# EasyEDA Pro project WearableGasDetect.eprj, board PCB2
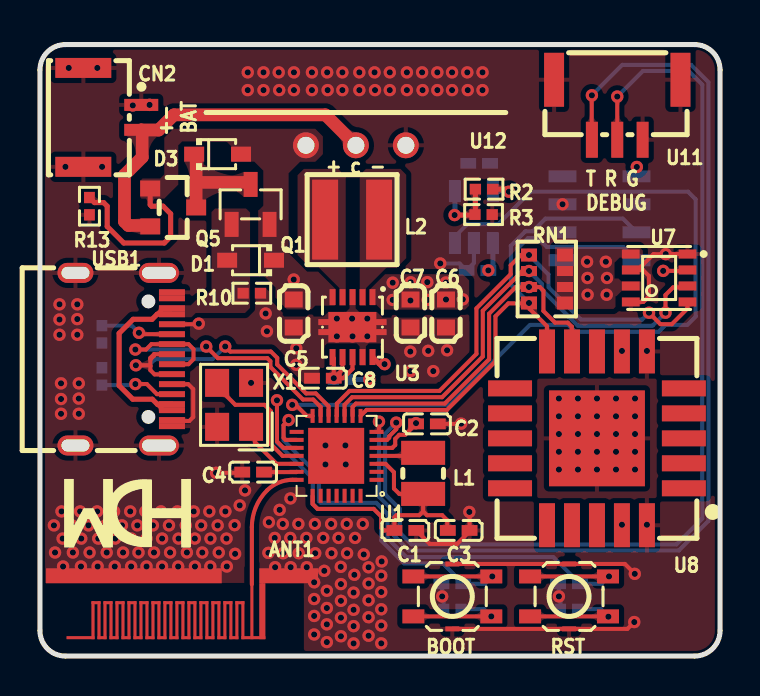
[diagram p8: board, top side]
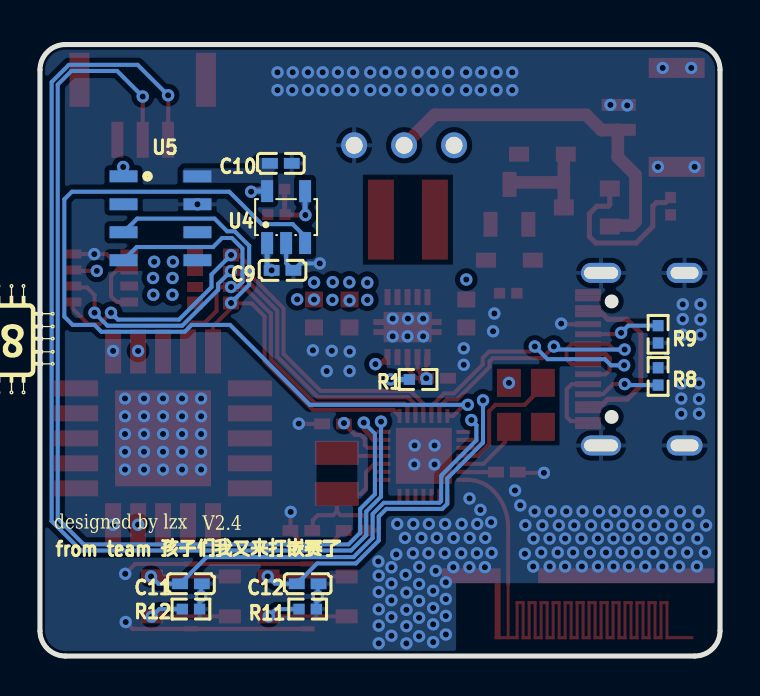
[diagram p9: board, bottom side, seen from below]

Outline 34.04 x 30.61 mm; copper layers: Top Layer, Inner1, Inner2, Bottom Layer. Coordinates in mm from the lower left corner of the outline.
Outline path: 0,29.34 0,1.27 arc(0.37,0.37) 1.27,0 32.77,0 arc(33.66,0.37) 34.04,1.27 34.04,29.34 arc(33.66,30.24) 32.77,30.61 1.27,30.61 arc(0.37,30.24) 0,29.34
Stack: Top Layer 0.035mm 外层铜厚1oz / Dielectric1 0.2104mm 7628 RC49% 8.6mil / Inner1 0.0152mm 内层铜厚 / Dielectric2 1.065mm 1.1mm H/HOZ 含铜 / Inner2 0.0152mm 内层铜厚 / Dielectric3 0.2104mm 7628 RC49% 8.6mil / Bottom Layer 0.035mm 外层铜厚1oz

## Design rules (mm)
template: JLCPCB Capability(Two Layers Board)
spacing copperThickness1oz (default): track to track 0.102, other pairs 0.152 to 0.3
spacing copperThickness2oz: track to track 0.203, other pairs 0.152 to 0.3
track width copperThickness1oz (default): min 0.127, default 0.254, max 2.54
track width copperThickness2oz: min 0.203, default 0.254, max 2.54
differential pair differentialPair (default): width min 0.127, default 0.254, max 2.54; gap min 0.152, default 0.152
via viaSize (default): diameter min 0.5, default 0.61, max 10; hole min 0.3, default 0.305, max 6.3

## Placement (name value [footprint] x y rotation side)
ANT1  -  [ANT-F-1-2.4G-0.8MMFR4-WCH]  10.6 3.59 180 top
BOOT  YTS-A007-1C  [SW-SMD_6P-L3.4-W3.4-P2.00-LS4.0]  20.64 2.98 0 top
C1  2.2uF  [C0402]  18.29 6.29 180 top
C2  2.2uF  [C0402]  19.37 11.62 180 top
C3  100nF  [C0402]  20.96 6.29 0 top
C4  1uF  [C0402]  10.67 9.21 180 top
C5  10uF  [C0603]  12.7 17.14 90 top
C6  10uF  [C0603]  20.32 17.14 270 top
C7  10uF  [C0603]  18.54 17.14 270 top
C8  100nF  [C0402]  14.16 13.91 0 top
C9  1uF  [C0402]  21.9 19.3 180 bottom
C10  1uF  [C0402]  21.98 24.66 0 bottom
C11  100nF  [C0402]  26.48 3.62 0 bottom
C12  100nF  [C0402]  20.64 3.62 0 bottom
CN2  WAFER-GH1.25-2PWB  [CONN-TH_2P-P1.25_XUNPU_WAFER-GH1.25-2PWB]  3.62 26.96 270 top
D1  1N5819WS  [SOD-323_L1.8-W1.3-LS2.5-RD]  10.54 19.81 180 top
D3  1N5819WS  [SOD-323_L1.8-W1.3-LS2.5-RD]  8.89 25.12 0 top
L1  10uH  [IND-SMD_L2.5-W2.0]  19.18 9.14 270 top
L2  2.2uH  [IND-SMD_L4.0-W4.0_VLS4012ET]  15.62 21.84 180 top
Q1  SI2301DS  [SOT-23-3_L2.9-W1.3-P1.90-LS2.4-BR]  10.54 22.61 270 top
Q5  -  [AO3401A_SOT-23-3]  6.67 22.45 180 top
R1  100  [R0402]  15.11 13.84 0 bottom
R2  8K  [R0402]  22.23 23.37 0 top
R3  50K  [R0402]  22.2 22.1 180 top
R8  5.1k  [R0402]  3.1 14 270 bottom
R9  5.1k  [R0402]  3.1 16.1 270 bottom
R10  100K  [R0402]  10.6 18.16 180 top
R11  10K  [R0402]  20.64 2.35 180 bottom
R12  10K  [R0402]  26.48 2.35 180 bottom
R13  10k  [R0402]  2.48 22.52 90 top
RN1  10kΩ  [RES-ARRAY-SMD_0603-8P-L3.2-W1.6-BL]  25.37 18.87 90 top
RST  YTS-A007-1C  [SW-SMD_6P-L3.4-W3.4-P2.00-LS4.0]  26.48 2.98 0 top
U1  CH582F  [QFN-28_L4.0-W4.0-P0.40-BL-EP2.8]  14.84 10.02 90 top
U3  TPS63001DRCT  [VSON-10_L3.0-W3.0-P0.50-TL-EP]  15.64 16.47 270 top
U4  SGM2019-ADJYN5G/TR  [SOT-23-5_L3.0-W1.7-P0.95-LS2.8-BR]  21.72 21.97 270 bottom
U5  -  [JED8101]  25.65 19.81 180 bottom
U7  BME688  [LGA-8_L3.0-W3.0-P0.80_BME688]  30.99 18.92 0 top
U8  SCD40-D-R1  [LGA-20_L10.1-W10.1-P1.25-TL]  27.88 10.9 180 top
U11  GH1.25-3PWBPZ  [CONN-SMD_GH1.25-3PWBPZ]  28.89 27.34 180 top
U12  PR5L5015-3P-C-H  [CONN-TH_PR5L5015-3P-C-H]  15.81 25.56 0 top
USB1  KH-TYPE-C-16P  [USB-C-SMD_KH-TYPE-C-16P]  4.19 14.86 270 top
X1  32MHz  [CRYSTAL-SMD_4P-L3.2-W2.5-BL]  9.72 12.57 90 top

## Footprints (pads in the part's own frame, mm; a bottom-side part is the same pattern mirrored in y, then rotated)
ANT-F-1-2.4G-0.8MMFR4-WCH
  rect 0.1x0.1 smd: 0(-0.525,0) 1(0,0)
AO3401A_SOT-23-3
  rect 1x0.8 smd: 1(1.15,-0.95) 2(1.15,0.95) 3(-1.15,0)
C0402
  rect 0.79x0.54 smd: 1(-0.545,0) 2(0.545,0)
C0603
  rect 0.8x0.9 smd: 1(-0.7,0) 2(0.7,0)
CONN-SMD_GH1.25-3PWBPZ
  rect 0.6x1.8 smd: 1(-1.27,1.501) 2(0,1.501) 3(1.27,1.501)
  rect 1x2.7 smd: 4(-3.163,-1.501) 5(3.163,-1.501)
CONN-TH_2P-P1.25_XUNPU_WAFER-GH1.25-2PWB
  rect 0.6x1.7 smd: 1(-0.625,1.45) 2(0.625,1.45)
  rect 1x2.8 smd: 3(-2.475,-1.45) 4(2.475,-1.45)
CONN-TH_PR5L5015-3P-C-H
  round 1.3 hole 0.85: 1(-2.5,0) 2(0,0) 3(2.5,0)
CRYSTAL-SMD_4P-L3.2-W2.5-BL
  rect 1.4x1.2 smd: 1(-1.1,-0.85) 2(1.1,-0.85) 3(1.1,0.85) 4(-1.1,0.85)
IND-SMD_L2.5-W2.0
  rect 1.2x2.2 smd: 1(1.028,0) 2(-1.028,0)
IND-SMD_L4.0-W4.0_VLS4012ET
  rect 1.3x4 smd: 1(-1.35,0) 2(1.35,0)
JED8101
  custom 1.4x0.6 smd: 1(-4.2,4.2) 2(-4.2,2.8) 3(-4.2,1.4) 4(-4.2,0) 5(-0.5,0) 6(-0.5,1.4) 7(-0.5,2.8) 8(-0.5,4.2)
LGA-8_L3.0-W3.0-P0.80_BME688
  rect 0.889x0.448 smd: 1(1.419,1.2) 2(1.419,0.4) 3(1.419,-0.4) 4(1.419,-1.2) 5(-1.419,-1.2) 6(-1.419,-0.4) 7(-1.419,0.4) 8(-1.419,1.2)
LGA-20_L10.1-W10.1-P1.25-TL
  rect 2.2x0.8 smd: 1(-4.35,2.5) 2(-4.35,1.25) 3(-4.35,0) 4(-4.35,-1.25) 5(-4.35,-2.5) 11(4.35,-2.5) 12(4.35,-1.25) 13(4.35,0) 14(4.35,1.25) 15(4.35,2.5)
  rect 0.8x2.2 smd: 6(-2.5,-4.35) 7(-1.25,-4.35) 8(0,-4.35) 9(1.25,-4.35) 10(2.5,-4.35) 16(2.5,4.35) 17(1.25,4.35) 18(0,4.35) 19(-1.25,4.35) 20(-2.5,4.35)
  rect 4.8x4.8 smd: 21(0,0)
QFN-28_L4.0-W4.0-P0.40-BL-EP2.8
  rect 0.2x0.7 smd: 1(-1.2,-2) 2(-0.8,-2) 3(-0.4,-2) 4(-0.001,-2) 5(0.4,-2) 6(0.8,-2) 7(1.2,-2) 15(1.2,2) 16(0.8,2) 17(0.4,2) 18(0,2) 19(-0.4,2) 20(-0.8,2) 21(-1.2,2)
  rect 0.7x0.2 smd: 8(2,-1.2) 9(2,-0.8) 10(2,-0.4) 11(1.999,0) 12(2,0.4) 13(2,0.8) 14(2,1.2) 22(-2,1.2) 23(-2,0.8) 24(-2,0.4) 25(-2,0) 26(-2,-0.4) 27(-2,-0.8) 28(-2,-1.2)
  rect 2.8x2.8 smd: 29(0.001,0.02)
R0402
  rect 0.566x0.54 smd: 1(-0.433,0) 2(0.433,0)
RES-ARRAY-SMD_0603-8P-L3.2-W1.6-BL
  rect 0.65x0.8 smd: 1(-1.2,-0.9) 4(1.2,-0.9) 5(1.2,0.9) 8(-1.2,0.9)
  rect 0.5x0.8 smd: 2(-0.4,-0.9) 3(0.4,-0.9) 6(0.4,0.9) 7(-0.4,0.9)
SOD-323_L1.8-W1.3-LS2.5-RD
  rect 1x0.75 smd: 1(-1.173,0) 2(1.173,0)
SOT-23-3_L2.9-W1.3-P1.90-LS2.4-BR
  rect 1.25x0.7 smd: 1(1,-0.95) 2(1,0.95) 3(-1,0)
SOT-23-5_L3.0-W1.7-P0.95-LS2.8-BR
  rect 1.1x0.6 smd: 1(1.3,-0.95) 2(1.3,0) 3(1.3,0.95) 4(-1.3,0.95) 5(-1.3,-0.95)
SW-SMD_6P-L3.4-W3.4-P2.00-LS4.0
  rect 1.1x0.7 smd: 1(-1.95,1) 2(1.95,1) 3(-1.95,-1) 4(1.95,-1)
  rect 0.7x0.25 smd: 5(0,1.625) 6(0,-1.625)
USB-C-SMD_KH-TYPE-C-16P
  oval 1x2 hole 0.6x1.7: 1(-4.32,1.765) 2(4.32,1.765)
  oval 1x1.8 hole 0.6x1.4: 3(-4.32,-2.415) 4(4.32,-2.415)
  rect 0.3x1.3 smd: A1(-3.35,2.415) A4(-2.55,2.415) A5(-1.25,2.415) A6(-0.25,2.415) A7(0.25,2.415) A8(1.25,2.415) A9(2.55,2.415) A12(3.35,2.415) B1(3.05,2.415) B4(2.25,2.415) B5(1.75,2.415) B6(0.75,2.415) B7(-0.75,2.415) B8(-1.75,2.415) B9(-2.25,2.415) B12(-3.05,2.415)
VSON-10_L3.0-W3.0-P0.50-TL-EP
  rect 0.8x0.3 smd: 1(-1.5,1) 2(-1.5,0.5) 3(-1.5,0) 4(-1.5,-0.5) 5(-1.5,-1) 6(1.5,-1) 7(1.5,-0.5) 8(1.5,0) 9(1.5,0.5) 10(1.5,1)
  custom 1.52x3.42 smd: 11(0.002,-0.009)

## Nets
As in the schematic.

Pads without a net: U1 1 2 15 23 24 25 26 27 28; U5 2 5 6; U8 1 2 3 4 5 8 11 12 13 14 15 16 17 18

## Via types
v1: diameter 0.62, hole 0.31, Top Layer to Bottom Layer, 272 vias

## Routing (per net, layer and track width the routed paths; a pad name or vN(x,y) marks a point on that pad's centre or on a via; arc(x,y) is an arc through that point)
1.4V: length 1.7
  Top Layer w0.254: R2.2 23.34,23.37 v1(23.47,23.24)
  Bottom Layer w0.254: v1(23.47,23.24) 23.44,23.27 U4.5
3.3V: length 6.6
  Top Layer w0.203: U7.2 32.36,19.28 v1(31.19,19.28) ; 18.82,11.66 C2.2 18.28,11.07 17.98,11.07 17.78,10.87 17.78,10.57 17.63,10.42 U1.5
  Top Layer w0.254: U3.10 17,14.61 v1(17.25,14.61)
  Bottom Layer w0.254: v1(29.87,24.48) 29.85,24.46 U5.1 ; v1(22.44,19.3) 22.67,19.53 U4.1
  vias: v1(17.65,18.69) v1(17.65,17.83) v1(18.55,18.71) v1(18.54,17.8) v1(18.82,11.66) v1(19.38,18.72) v1(19.4,17.83) v1(20.32,18.7) v1(20.32,17.84) v1(21.16,17.85) v1(27.38,19.74) v1(27.4,18.92) v1(27.41,18.08) v1(28.32,19.74) v1(28.38,18.92) v1(28.36,18.08) v1(29.13,15.27) v1(29.13,6.57)
GND: length 41.9
  Top Layer w0.203: v1(21.49,7.21) 21.5,7.2 C3.2 21.5,6.23 20.88,5.61 19.51,5.61 C1.1 ; C2.1 21.07,11.62 v1(21.08,11.63) ; 29.92,19.32 30.18,19.32 30.48,19.02 30.48,18.01 30.19,17.72 U7.5 ; 29.92,19.32 30.71,20.12 v1(31.32,20.12) 31.32,20.12 U7.1 ; 29.92,19.32 U7.7 ; C4.2 10.09,9.17 v1(8.81,9.17) ; 6.61,13.61 7.42,13.61 7.67,13.36 7.67,11.96 7.47,11.76 6.66,11.76 6.61,11.81 ; v1(29.77,4.11) 29.27,4.61 RST.5 BOOT.5 ; v1(7.95,16.64) 7.92,16.61 6.61,16.61 ; BOOT.6 RST.6 29.4,1.36 v1(29.74,1.7)
  Bottom Layer w0.203: R11.2 20.2,2.91 v1(20.13,2.98) 20.13,3.58 C12.1 ; U4.2 21.72,19.67 21.35,19.3 21,19.65 v1(20.03,19.65) ; R12.2 26.05,2.91 v1(25.97,2.98) 25.97,3.58 C11.1
  vias: v1(0.7,6.54) v1(0.75,5.18) v1(0.98,17.61) v1(0.98,16.84) v1(0.98,16.08) v1(1.05,13.65) v1(1.05,12.86) v1(1.05,12.13) v1(1.08,7.24) v1(1.14,5.88) v1(1.16,4.48) v1(1.27,24.49) v1(1.44,29.44) v1(1.59,6.54) v1(1.65,5.18) v1(1.87,17.61) v1(1.87,16.87) v1(1.87,16.08) v1(1.94,13.65) v1(1.94,12.89) v1(1.94,12.13) v1(2.01,7.24) v1(2.05,4.48) v1(2.07,5.88) v1(2.43,6.54) v1(2.48,5.18) v1(2.87,29.44) v1(2.86,7.24) v1(2.92,5.88) v1(2.89,4.48) v1(3.11,24.49) v1(3.29,6.54) v1(3.34,5.18) v1(3.71,7.24) v1(3.74,4.48) v1(3.76,5.88) v1(4.1,6.54) v1(4.16,5.18) v1(4.52,7.24) v1(4.65,27.56) v1(4.57,5.88) v1(4.56,4.48) v1(4.87,6.54) v1(4.93,5.18) v1(5.28,7.24) v1(5.33,5.88) v1(5.33,4.48) v1(5.49,27.59) v1(5.65,6.54) v1(5.71,5.18) v1(6.06,7.24) v1(6.11,5.88) v1(6.11,4.48) v1(6.46,6.54) v1(6.51,5.18) v1(6.88,7.24) v1(6.94,5.88) v1(6.92,4.48) v1(7.3,6.54) v1(7.35,5.18) v1(7.7,7.24) v1(7.75,5.88) v1(7.76,4.48) v1(8.07,6.54) v1(8.12,5.18) v1(8.48,7.24) v1(8.53,5.88) v1(8.53,4.48) v1(8.89,6.54) v1(8.95,5.18) v1(9.28,7.24) v1(9.34,5.88) v1(9.35,4.48) v1(9.74,6.55) v1(9.77,5.12) v1(10,7.54) v1(10.26,8.29) v1(10.4,29.22) v1(10.4,28.33) v1(10.57,13.67) v1(11.19,29.22) v1(11.19,28.33) v1(11.3,17.14) v1(11.36,16.26) v1(11.46,6.7) v1(11.43,5.16) v1(11.75,5.91) v1(11.77,4.45) v1(11.95,29.22) v1(11.97,28.33) v1(11.99,7.32) v1(12.15,6.61) v1(12.17,5.14) v1(12.54,7.89) v1(12.53,5.91) v1(12.55,4.45) v1(12.71,29.22) v1(12.71,28.33) v1(12.83,15.41) v1(12.83,14.58) v1(12.93,6.61) v1(12.95,5.14) v1(13.33,5.91) v1(13.35,4.45) v1(13.61,29.22) v1(13.61,28.33) v1(13.76,6.61) v1(13.72,3.69) v1(13.72,2.85) v1(13.72,2.01) v1(13.72,1.08) v1(13.78,5.14) v1(14.17,5.91) v1(14.23,4.27) v1(14.29,10.54) v1(14.29,9.59) v1(14.36,3.27) v1(14.36,2.4) v1(14.36,1.59) v1(14.36,0.7) v1(14.37,29.22) v1(14.4,28.33) v1(14.57,6.61) v1(14.59,5.14) v1(14.86,16.89) v1(14.86,16) v1(14.95,5.91) v1(15.05,4.46) v1(15.14,29.22) v1(15.14,28.33) v1(15.06,3.6) v1(15.06,2.76) v1(15.06,1.92) v1(15.06,0.99) v1(15.29,10.54) v1(15.3,9.59) v1(15.35,6.61) v1(15.37,5.14) v1(15.62,16.89) v1(15.64,16) v1(15.73,4.07) v1(15.7,3.18) v1(15.7,2.31) v1(15.7,1.5) v1(15.7,0.63) v1(15.77,5.91) v1(15.98,29.22) v1(15.98,28.33) v1(16.16,6.61) v1(16.21,5.09) v1(16.38,16.89) v1(16.38,16) v1(16.45,4.44) v1(16.45,3.63) v1(16.45,2.79) v1(16.45,1.94) v1(16.45,1.02) v1(16.75,29.22) v1(16.77,28.33) v1(17.1,4.73) v1(17.08,4.02) v1(17.08,3.2) v1(17.08,2.34) v1(17.08,1.52) v1(17.08,0.63) v1(17.51,29.22) v1(17.51,28.33) v1(18.36,29.22) v1(18.36,28.33) v1(18.53,15.24) v1(18.54,14.26) v1(19.13,29.22) v1(19.15,28.33) v1(19.43,15.28) v1(19.69,14.26) v1(19.89,29.22) v1(19.89,28.33) v1(20.38,15.3) v1(20.62,29.22) v1(20.62,28.33) v1(21.39,29.22) v1(21.41,28.33) v1(22.15,29.22) v1(22.15,28.33) v1(25.97,12.89) v1(25.97,12) v1(25.97,11.11) v1(25.97,10.22) v1(25.97,9.33) v1(26.15,22.61) v1(26.92,12.89) v1(26.92,12) v1(26.92,11.11) v1(26.92,10.22) v1(26.92,9.33) v1(27.88,12.89) v1(27.88,12) v1(27.88,11.11) v1(27.88,10.22) v1(27.88,9.33) v1(28.83,12.89) v1(28.83,12) v1(28.83,11.11) v1(28.83,10.22) v1(28.83,9.33) v1(29.78,12.89) v1(29.78,12) v1(29.78,11.11) v1(29.78,10.22) v1(29.78,9.33) v1(30.38,15.27) v1(30.38,6.57)
VBUS: length 10.4
  Top Layer w0.203: 5.87,17.11 6.17,17.41 6.61,17.41 ; 5.88,12.6 6.17,12.31 6.61,12.31
  Top Layer w0.254: 6.61,12.61 6.6,12.6 5.88,12.6 5.62,12.86 4.65,12.86 3.96,13.54 3.96,16.15 4.66,16.86 5.61,16.86 5.87,17.11 6.61,17.11
VIN: length 18.4
  Top Layer w0.254: R13.2 2.73,22.7 3.19,22.7 3.37,22.52 3.37,21.5 4.19,20.68 6.22,20.68 6.54,20.99 6.54,22.14 6.16,22.52 5.59,22.52 5.52,22.59 Q5.1
  Inner2 w0.254: v1(16.48,13.84) 15.93,13.28 14.4,13.28 13.64,14.05 13.64,17.91 v1(12.7,18.85)
  Bottom Layer w0.254: 15.55,13.84 v1(16.48,13.84)
ANT: length 6.5
  Top Layer w0.203: U1.21 12.64,8.82 arc(11.95,8.68) 11.37,8.29 arc(10.8,7.45) 10.6,6.45 ANT1.1
BOOT: length 24.5
  Top Layer w0.203: BOOT.1 BOOT.2 ; v1(11.86,12.8) 11.86,10.74 12.19,10.42 U1.17
  Bottom Layer w0.203: v1(11.86,12.8) 11.86,10.68 13.65,8.89 13.65,7.62 13.91,7.37 16.7,7.37 17.08,6.98 17.08,5.78 18.22,4.64 20.17,4.64 C12.2 22.27,3.62 v1(22.64,3.98)
CHARGE: length 18
  Top Layer w0.635: Q5.2 5.47,21.55 4.43,21.55 4.23,21.75 4.23,24.08 5.12,24.97 5.12,26.29 5.08,26.33 ; U12.2 14.29,27.09 6.7,27.09 5.94,26.33 5.08,26.33 ; 5.08,26.33 CN2.2
I2C0SCL: length 26.8
  Top Layer w0.203: 24.42,18.47 24.41,18.46 23.8,18.46 22.48,17.14 22.48,14.86 20.26,12.64 15.81,12.64 15.65,12.47 U1.9 ; 26.63,15.27 26.62,15.28 26.62,16.48 26.42,16.69 25.78,16.69 25.2,17.27 25.2,18.29 25.01,18.47 v1(24.47,18.47)
  Bottom Layer w0.203: U5.4 29.19,20.47 25.37,20.47 24.92,20.92 24.43,20.92 23.9,20.4 23.9,18.72 24.15,18.47 v1(24.47,18.47)
I2C0SDA: length 25.2
  Top Layer w0.203: U1.8 16.34,12.32 20.37,12.32 22.8,14.75 22.8,17 23.45,17.65 24.4,17.65 ; 25.38,15.27 25.38,16.51 24.51,17.37 24.51,17.64 v1(24.47,17.67)
  Bottom Layer w0.203: v1(24.47,17.67) 23.57,18.58 23.57,20.53 24.29,21.26 24.66,21.26 25.3,21.89 29.17,21.89 U5.3
I2C1SCL: length 25.5
  Top Layer w0.203: U7.4 32.41,17.4 31.62,16.61 31.05,16.61 v1(30.48,17.18) ; 14.84,12.02 14.86,12.03 14.86,12.64 15.49,13.27 19.99,13.27 21.84,15.12 21.84,17.4 23.56,19.11 23.56,19.56 24.06,20.06 24.41,20.06 24.42,20.07
  Bottom Layer w0.203: v1(30.48,17.18) 30.14,16.84 27.08,16.84 25.45,18.47 25.45,19.1 v1(24.47,20.07)
I2C1SDA: length 24.4
  Top Layer w0.203: U7.3 32.34,18.45 31.69,18.45 31.31,18.07 v1(31.31,17.18) ; 24.44,19.26 24.43,19.25 24.13,19.25 22.16,17.29 22.16,14.99 20.12,12.95 15.62,12.95 15.25,12.58 U1.10
  Bottom Layer w0.203: v1(24.47,19.27) 25.12,18.63 25.12,18.33 26.91,16.54 30.66,16.54 v1(31.31,17.18)
RST: length 27.6
  Top Layer w0.203: v1(12.45,11.81) 12.19,11.56 12.19,10.92 12.29,10.82 U1.16 ; RST.1 RST.2
  Bottom Layer w0.203: v1(28.48,3.98) 28.11,3.62 C11.2 25.69,4.95 18.34,4.95 17.39,5.91 17.39,7.11 16.83,7.67 14.05,7.67 13.96,7.76 13.96,9.02 13.91,9.06 13.91,9.08 12.19,10.8 12.19,11.56 v1(12.45,11.81)
RX1: length 52.5
  Top Layer w0.203: U1.6 17.37,10.82 17.48,10.93 17.48,11 17.83,11.35 v1(17.83,11.68) ; U11.2 v1(28.89,28)
  Bottom Layer w0.203: v1(28.89,28) 30.18,29.29 32.46,29.29 33.15,28.6 33.15,6.88 31.85,5.59 18.59,5.59 18.01,6.17 18.01,7.37 17.27,8.1 17.27,11.13 v1(17.83,11.68)
SGM2019EN: length 42.9
  Top Layer w0.203: U1.14 13.36,12.02 12.8,12.57 v1(12.62,12.57)
  Bottom Layer w0.203: v1(12.62,12.57) 20.52,12.57 24.52,16.57 26.44,16.57 26.79,16.23 30.96,16.23 31.31,16.57 32.4,16.57 32.82,16.99 32.82,22.86 32.44,23.24 24.56,23.24 22.94,21.62 21.39,21.62 20.77,21 U4.3
TX1: length 54.3
  Top Layer w0.203: 27.61,25.85 27.61,28.06 ; v1(16.97,11.73) 16.97,11.28 16.91,11.22 U1.7
  Top Layer w0.254: 27.61,28.06 v1(27.62,28.07) ; U11.3 27.61,25.85
  Bottom Layer w0.203: v1(27.62,28.07) 29.15,29.59 32.59,29.59 33.45,28.73 33.45,6.76 31.98,5.28 18.47,5.28 17.7,6.05 17.7,7.24 16.97,7.98 v1(16.97,11.73)
UD+: length 16
  Top Layer w0.203: 6.61,14.11 6.59,14.1 5.74,14.1 5.52,14.31 5.52,14.52 ; 5.71,15.11 6.61,15.11 ; 5.71,15.11 5.52,14.92 5.52,14.85 ; 5.71,15.11 5.71,15.03 5.52,14.85 ; v1(4.8,14.55) 5.49,14.55 5.52,14.52 ; U1.12 14.45,12.5 13.8,13.14 13.32,13.14 11.87,14.59 11.87,14.92 11.56,15.24 9.53,15.24 v1(9.27,15.49) ; 5.52,14.52 5.52,14.85
  Bottom Layer w0.203: v1(4.8,14.55) 5.46,14.55 5.77,14.86 8.64,14.86 v1(9.27,15.49)
UD-: length 16
  Top Layer w0.203: 6.61,14.61 7.43,14.61 7.68,14.86 7.68,15.36 7.44,15.61 5.58,15.61 5.31,15.34 v1(4.78,15.34) ; U1.13 14.05,12.47 13.68,12.84 13.16,12.84 11.53,14.47 11.53,14.76 11.38,14.91 8.9,14.91 v1(8.32,15.49)
  Bottom Layer w0.203: v1(4.78,15.34) 8.17,15.34 v1(8.32,15.49)
X32MI: length 3.3
  Top Layer w0.203: 10.76,11.47 10.76,10.71 11.84,9.62 U1.19
X32MO: length 6.5
  Top Layer w0.203: 9.06,13.67 9.06,13.3 9.78,12.57 11.24,12.57 11.56,12.26 11.56,10.6 12.14,10.02 U1.18
$1N627: length 2.4
  Top Layer w0.203: L1.2 19.02,10.02 U1.4
$1N739: length 13.8
  Top Layer w0.203: 19.18,7.24 19.37,7.05 20.13,7.05 20.38,6.79 20.38,6.31 C3.1 ; 19.18,7.24 18.99,7.05 17.84,7.05 17.74,6.95 C1.2 17.21,6.29 17.08,6.41 17.08,6.98 16.7,7.37 13.89,7.37 13.65,7.61 U1.22 ; 19.18,7.24 L1.1 17.98,8.12 17.72,8.38 17.72,9.2 17.3,9.62 U1.3
$1N927: length 1.6
  Top Layer w0.203: U1.20 12.83,9.21 C4.1
$1N1786: length 4.1
  Top Layer w0.203: v1(14.71,13.91) 15.18,13.91 15.64,14.37 U3.8 ; v1(14.71,13.91) 14.71,14.9 U3.6 ; v1(14.71,13.91) 15.14,14.34 U3.7
$1N2503: length 3.5
  Top Layer w0.254: v1(20.75,22.07) 21.74,22.07 R3.2 21.79,22.12 21.79,23.37
  Bottom Layer w0.254: v1(20.75,22.07) 20.77,22.09 U4.4
$1N4772: length 3.7
  Top Layer w0.203: 6.61,13.11 5.85,13.11 5.35,13.61 v1(4.78,13.61)
  Bottom Layer w0.203: R8.2 4.72,13.56 v1(4.78,13.61)
$1N4833: length 3.7
  Top Layer w0.203: v1(4.95,16.18) 5.02,16.11 6.61,16.11
  Bottom Layer w0.203: R9.1 4.6,16.54 v1(4.95,16.18)
$1N5754: length 5.6
  Top Layer w0.203: RST.3 RST.4
  Bottom Layer w0.203: R12.1 28.07,2.35 v1(28.45,1.97)
$1N5788: length 5.6
  Top Layer w0.203: BOOT.3 v1(22.59,1.98)
  Bottom Layer w0.203: R11.1 22.22,2.35 v1(22.59,1.98)
$1N13400: length 5.5
  Top Layer w0.635: Q1.3 10.44,23.71 7.82,23.71 ; 7.82,23.71 Q5.3 ; 7.82,23.71 7.82,25.02 D3.1

## Copper pours and planes (outline as drawn; the poured copper is in the pictures)
1.4V on Bottom Layer: 22.15,24.92 26.9,24.92 26.9,22.73 22.15,22.73
3.3V on Top Layer: 25.78,20.47 30.18,20.47 30.18,17.37 25.78,17.37
3.3V on Top Layer: 16.52,19.11 21.48,19.11 21.48,17.34 16.52,17.34
3.3V on Inner2: 1.4,29.25 1.4,9.93 15.44,9.93 18.29,6.78 18.29,1.88 18.73,1.44 32.58,1.44 32.58,29.12 32.64,29.18 1.46,29.18
GND on Top Layer: 0,30.61 34.04,30.61 34.04,0 0,0
GND on Top Layer: 10.78,18.43 21.49,18.43 21.49,13.61 10.78,13.61
GND on Top Layer: 0.25,4.99 10.22,4.99 10.22,3.66 0.25,3.66
GND on Top Layer: 10.98,4.99 14.88,4.99 14.88,2.9 10.98,2.9
GND on Top Layer: 15.23,18.37 16.13,18.37 16.13,16.46 15.23,16.46
GND on Bottom Layer: 0,30.61 34.04,30.61 34.04,0 0,0
GND on Inner1: 0,30.61 34.04,30.61 34.04,0 0,0
VBUS on Top Layer: 5.96,22.4 10.52,22.4 10.52,16.96 5.96,16.96
VIN on Top Layer: 5.02,26.39 14.16,26.39 14.16,22.16 5.02,22.16
VIN on Top Layer: 10.92,22.33 14.8,22.33 14.8,17.36 10.92,17.36
$1N1570 on Top Layer: 16,24.38 18.33,24.38 18.33,17.53 16,17.53
$1N1583 on Top Layer: 12.89,24.38 15.3,24.38 15.3,17.53 12.89,17.53

Small or netless copper shapes (teardrops, artwork), in the pictures only: 125 on Top Layer, 56 on Bottom Layer, 2 on Inner2

## Text on the board
Bottom Silkscreen Layer: V2.4 | designed by lzx | from team 孩子们我又来打嵌赛了
Top Silkscreen Layer: + c - | T R G | DEBUG | -+ | BAT
